# EasyEDA Pro project PR.eprj, schematic Schematic1
Create Date: 2023-11-19; Page Name: P1; Project Name: PR; Schematic Name: Schematic1; Update Date: 2023-11-19; Company: 嘉立创EDA; Page Size: A4; Version: V1.0
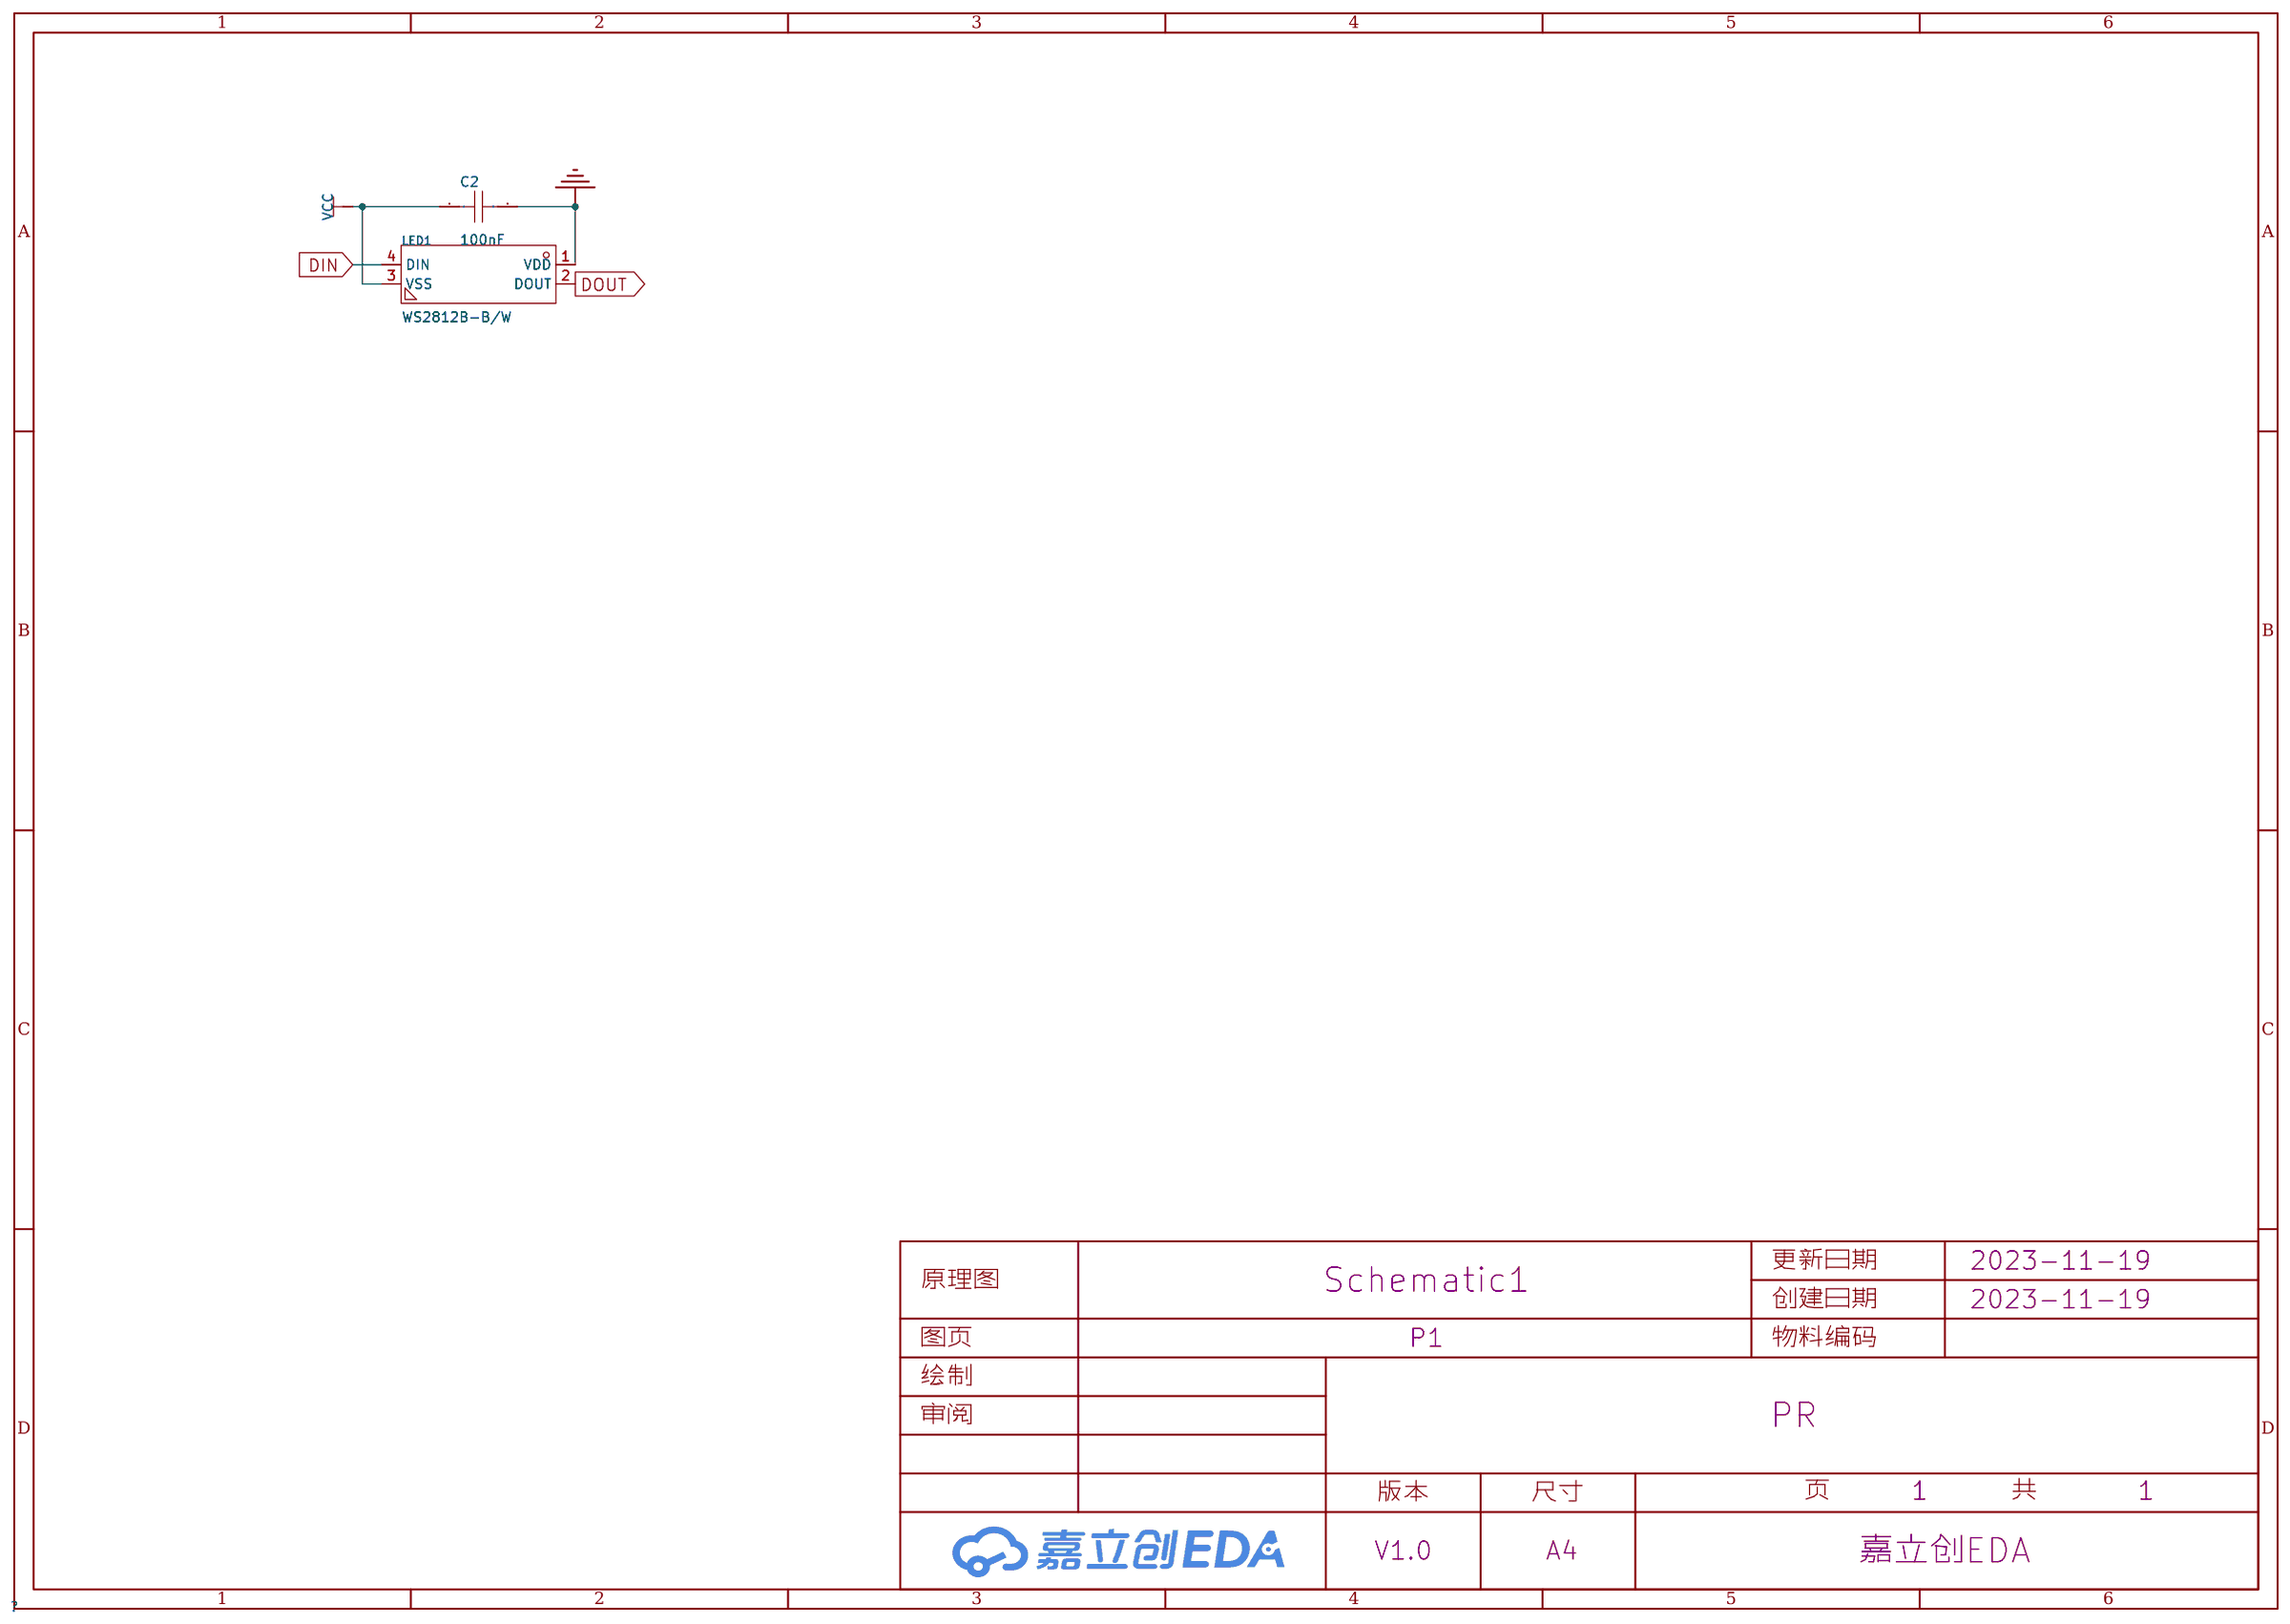
[diagram p1: schematic sheet]

## Parts
C2  100nF  [C0603]
LED1  WS2812B-B/W  [LED-SMD_4P-L5.0-W5.0-BL_TC5050RGB]

## Library data of the parts
C2 = CAP_0603: Supplier Footprint: 0603
LED1 = WS2812B-B/W: 发光颜色:RGB三色;; LCSC Part Name: RGB三色 （注意防潮，请查阅规格书中对应具体内容）; Supplier Part: C114586; Manufacturer: worldsemi; Supplier Footprint: SMD5050; JLCPCB Part Class: 扩展库; Datasheet: https://atta.szlcsc.com/upload/public/pdf/source/20200615/C114586_26EB6813EC9F2A3F6C7FBB2AD75DE01F.pdf; Supplier: LCSC; Emitted Color: RGB三色

## Nets
GND: C2.2 LED1.1(VDD)
VCC: C2.1 LED1.3(VSS)
DIN: LED1.4(DIN)
DOUT: LED1.2(DOUT)
